# EasyEDA Pro project wukong01-Y003-HTOL.eprj, board PCB1 (continued)
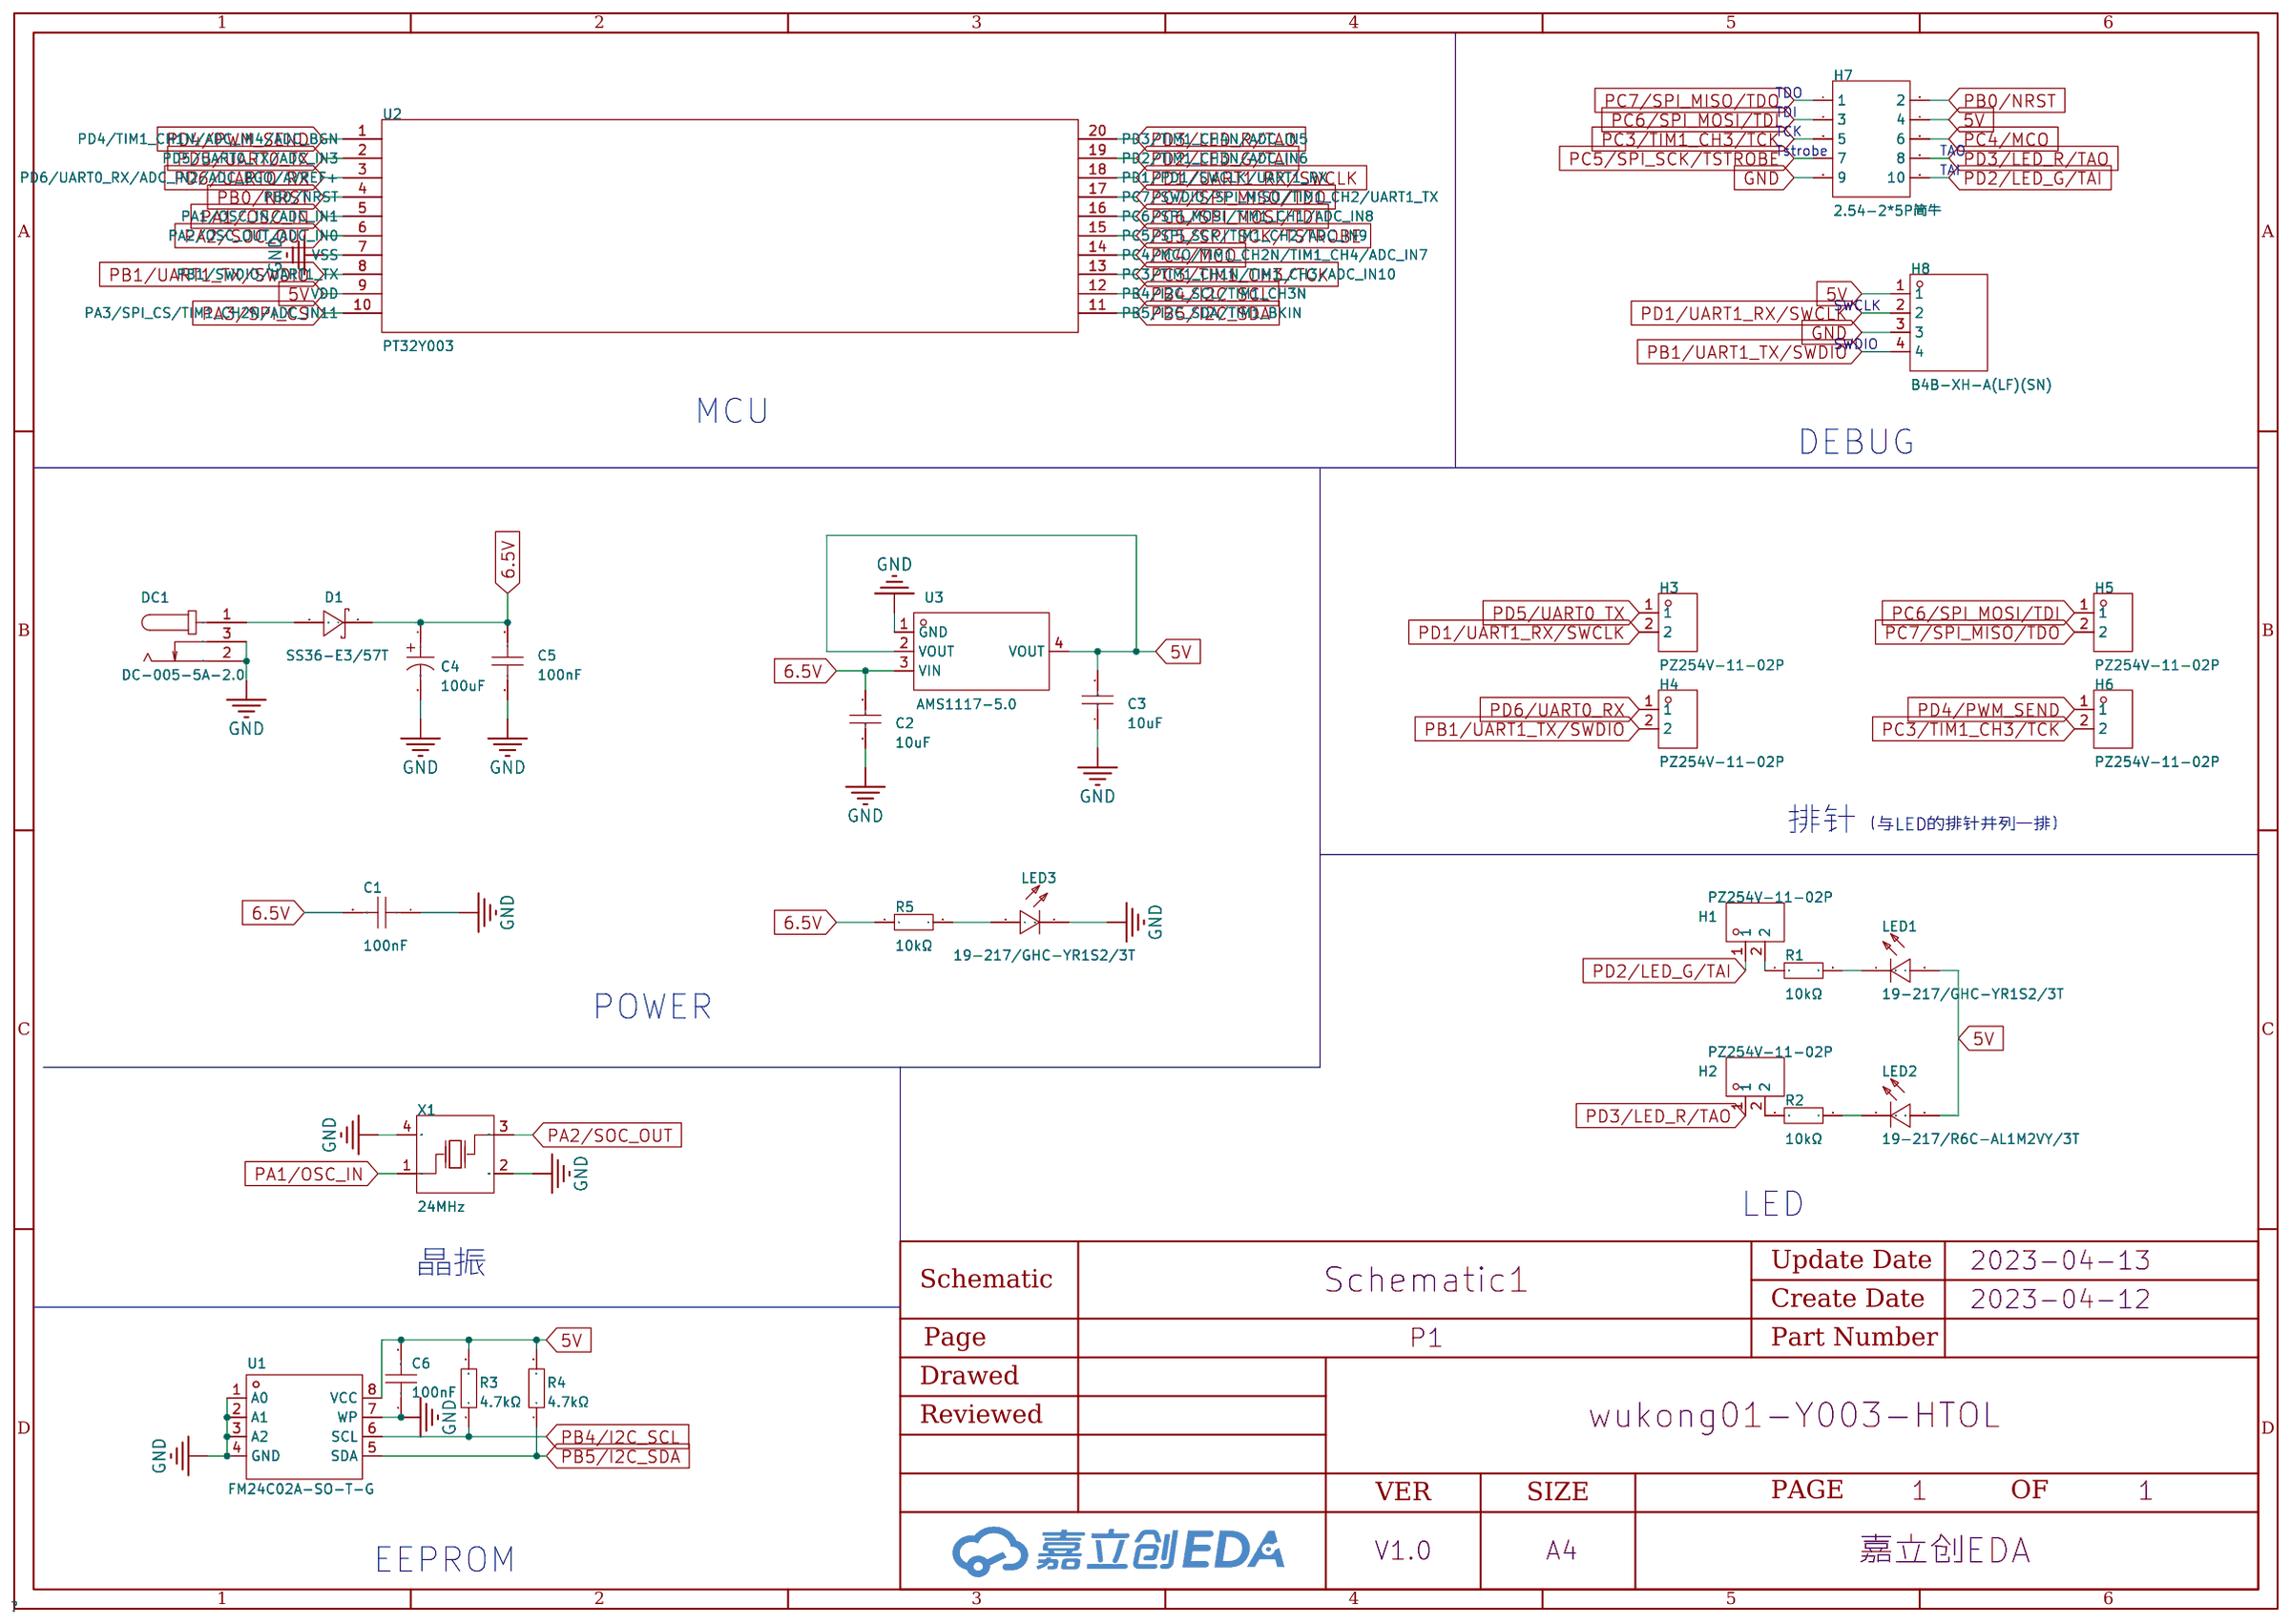
[diagram p0: schematic sheet]
## Nets (continued)
PB4/I2C_SCL: R3.1 R3#2.1 R3#3.1 R3#4.1 R3#5.1 R3#6.1 R3#7.1 R3#8.1 R3#9.1 R3#10.1 R3#11.1 R3#12.1 R3#13.1 R3#14.1 R3#15.1 R3#16.1 R3#17.1 R3#18.1 R3#19.1 R3#20.1 R3#21.1 R3#22.1 R3#23.1 R3#24.1 R3#25.1 R3#26.1 R3#27.1 R3#28.1 R3#29.1 R3#30.1 R3#31.1 R3#32.1 R3#33.1 R3#34.1 R3#35.1 R3#36.1 R3#37.1 R3#38.1 R3#39.1 R3#40.1 U1.6 U1#2.6 U1#3.6 U1#4.6 U1#5.6 U1#6.6 U1#7.6 U1#8.6 U1#9.6 U1#10.6 U1#11.6 U1#12.6 U1#13.6 U1#14.6 U1#15.6 U1#16.6 U1#17.6 U1#18.6 U1#19.6 U1#20.6 U1#21.6 U1#22.6 U1#23.6 U1#24.6 U1#25.6 U1#26.6 U1#27.6 U1#28.6 U1#29.6 U1#30.6 U1#31.6 U1#32.6 U1#33.6 U1#34.6 U1#35.6 U1#36.6 U1#37.6 U1#38.6 U1#39.6 U1#40.6 U2.12 U2#2.12 U2#3.12 U2#4.12 U2#5.12 U2#6.12 U2#7.12 U2#8.12 U2#9.12 U2#10.12 U2#11.12 U2#12.12 U2#13.12 U2#14.12 U2#15.12 U2#16.12 U2#17.12 U2#18.12 U2#19.12 U2#20.12 U2#21.12 U2#22.12 U2#23.12 U2#24.12 U2#25.12 U2#26.12 U2#27.12 U2#28.12 U2#29.12 U2#30.12 U2#31.12 U2#32.12 U2#33.12 U2#34.12 U2#35.12 U2#36.12 U2#37.12 U2#38.12 U2#39.12 U2#40.12
PB5/I2C_SDA: R4.1 R4#2.1 R4#3.1 R4#4.1 R4#5.1 R4#6.1 R4#7.1 R4#8.1 R4#9.1 R4#10.1 R4#11.1 R4#12.1 R4#13.1 R4#14.1 R4#15.1 R4#16.1 R4#17.1 R4#18.1 R4#19.1 R4#20.1 R4#21.1 R4#22.1 R4#23.1 R4#24.1 R4#25.1 R4#26.1 R4#27.1 R4#28.1 R4#29.1 R4#30.1 R4#31.1 R4#32.1 R4#33.1 R4#34.1 R4#35.1 R4#36.1 R4#37.1 R4#38.1 R4#39.1 R4#40.1 U1.5 U1#2.5 U1#3.5 U1#4.5 U1#5.5 U1#6.5 U1#7.5 U1#8.5 U1#9.5 U1#10.5 U1#11.5 U1#12.5 U1#13.5 U1#14.5 U1#15.5 U1#16.5 U1#17.5 U1#18.5 U1#19.5 U1#20.5 U1#21.5 U1#22.5 U1#23.5 U1#24.5 U1#25.5 U1#26.5 U1#27.5 U1#28.5 U1#29.5 U1#30.5 U1#31.5 U1#32.5 U1#33.5 U1#34.5 U1#35.5 U1#36.5 U1#37.5 U1#38.5 U1#39.5 U1#40.5 U2.11 U2#2.11 U2#3.11 U2#4.11 U2#5.11 U2#6.11 U2#7.11 U2#8.11 U2#9.11 U2#10.11 U2#11.11 U2#12.11 U2#13.11 U2#14.11 U2#15.11 U2#16.11 U2#17.11 U2#18.11 U2#19.11 U2#20.11 U2#21.11 U2#22.11 U2#23.11 U2#24.11 U2#25.11 U2#26.11 U2#27.11 U2#28.11 U2#29.11 U2#30.11 U2#31.11 U2#32.11 U2#33.11 U2#34.11 U2#35.11 U2#36.11 U2#37.11 U2#38.11 U2#39.11 U2#40.11
PC3/TIM1_CH3/TCK: H6.2 H6#2.2 H6#3.2 H6#4.2 H6#5.2 H6#6.2 H6#7.2 H6#8.2 H6#9.2 H6#10.2 H6#11.2 H6#12.2 H6#13.2 H6#14.2 H6#15.2 H6#16.2 H6#17.2 H6#18.2 H6#19.2 H6#20.2 H6#21.2 H6#22.2 H6#23.2 H6#24.2 H6#25.2 H6#26.2 H6#27.2 H6#28.2 H6#29.2 H6#30.2 H6#31.2 H6#32.2 H6#33.2 H6#34.2 H6#35.2 H6#36.2 H6#37.2 H6#38.2 H6#39.2 H6#40.2 H7.5 H7#2.5 H7#3.5 H7#4.5 H7#5.5 H7#6.5 H7#7.5 H7#8.5 H7#9.5 H7#10.5 H7#11.5 H7#12.5 H7#13.5 H7#14.5 H7#15.5 H7#16.5 H7#17.5 H7#18.5 H7#19.5 H7#20.5 H7#21.5 H7#22.5 H7#23.5 H7#24.5 H7#25.5 H7#26.5 H7#27.5 H7#28.5 H7#29.5 H7#30.5 H7#31.5 H7#32.5 H7#33.5 H7#34.5 H7#35.5 H7#36.5 H7#37.5 H7#38.5 H7#39.5 H7#40.5 U2.13 U2#2.13 U2#3.13 U2#4.13 U2#5.13 U2#6.13 U2#7.13 U2#8.13 U2#9.13 U2#10.13 U2#11.13 U2#12.13 U2#13.13 U2#14.13 U2#15.13 U2#16.13 U2#17.13 U2#18.13 U2#19.13 U2#20.13 U2#21.13 U2#22.13 U2#23.13 U2#24.13 U2#25.13 U2#26.13 U2#27.13 U2#28.13 U2#29.13 U2#30.13 U2#31.13 U2#32.13 U2#33.13 U2#34.13 U2#35.13 U2#36.13 U2#37.13 U2#38.13 U2#39.13 U2#40.13
PC4/MCO: H7.6 H7#2.6 H7#3.6 H7#4.6 H7#5.6 H7#6.6 H7#7.6 H7#8.6 H7#9.6 H7#10.6 H7#11.6 H7#12.6 H7#13.6 H7#14.6 H7#15.6 H7#16.6 H7#17.6 H7#18.6 H7#19.6 H7#20.6 H7#21.6 H7#22.6 H7#23.6 H7#24.6 H7#25.6 H7#26.6 H7#27.6 H7#28.6 H7#29.6 H7#30.6 H7#31.6 H7#32.6 H7#33.6 H7#34.6 H7#35.6 H7#36.6 H7#37.6 H7#38.6 H7#39.6 H7#40.6 U2.14 U2#2.14 U2#3.14 U2#4.14 U2#5.14 U2#6.14 U2#7.14 U2#8.14 U2#9.14 U2#10.14 U2#11.14 U2#12.14 U2#13.14 U2#14.14 U2#15.14 U2#16.14 U2#17.14 U2#18.14 U2#19.14 U2#20.14 U2#21.14 U2#22.14 U2#23.14 U2#24.14 U2#25.14 U2#26.14 U2#27.14 U2#28.14 U2#29.14 U2#30.14 U2#31.14 U2#32.14 U2#33.14 U2#34.14 U2#35.14 U2#36.14 U2#37.14 U2#38.14 U2#39.14 U2#40.14
PC5/SPI_SCK/TSTROBE: H7.7 H7#2.7 H7#3.7 H7#4.7 H7#5.7 H7#6.7 H7#7.7 H7#8.7 H7#9.7 H7#10.7 H7#11.7 H7#12.7 H7#13.7 H7#14.7 H7#15.7 H7#16.7 H7#17.7 H7#18.7 H7#19.7 H7#20.7 H7#21.7 H7#22.7 H7#23.7 H7#24.7 H7#25.7 H7#26.7 H7#27.7 H7#28.7 H7#29.7 H7#30.7 H7#31.7 H7#32.7 H7#33.7 H7#34.7 H7#35.7 H7#36.7 H7#37.7 H7#38.7 H7#39.7 H7#40.7 U2.15 U2#2.15 U2#3.15 U2#4.15 U2#5.15 U2#6.15 U2#7.15 U2#8.15 U2#9.15 U2#10.15 U2#11.15 U2#12.15 U2#13.15 U2#14.15 U2#15.15 U2#16.15 U2#17.15 U2#18.15 U2#19.15 U2#20.15 U2#21.15 U2#22.15 U2#23.15 U2#24.15 U2#25.15 U2#26.15 U2#27.15 U2#28.15 U2#29.15 U2#30.15 U2#31.15 U2#32.15 U2#33.15 U2#34.15 U2#35.15 U2#36.15 U2#37.15 U2#38.15 U2#39.15 U2#40.15
PC6/SPI_MOSI/TDI: H5.1 H5#2.1 H5#3.1 H5#4.1 H5#5.1 H5#6.1 H5#7.1 H5#8.1 H5#9.1 H5#10.1 H5#11.1 H5#12.1 H5#13.1 H5#14.1 H5#15.1 H5#16.1 H5#17.1 H5#18.1 H5#19.1 H5#20.1 H5#21.1 H5#22.1 H5#23.1 H5#24.1 H5#25.1 H5#26.1 H5#27.1 H5#28.1 H5#29.1 H5#30.1 H5#31.1 H5#32.1 H5#33.1 H5#34.1 H5#35.1 H5#36.1 H5#37.1 H5#38.1 H5#39.1 H5#40.1 H7.3 H7#2.3 H7#3.3 H7#4.3 H7#5.3 H7#6.3 H7#7.3 H7#8.3 H7#9.3 H7#10.3 H7#11.3 H7#12.3 H7#13.3 H7#14.3 H7#15.3 H7#16.3 H7#17.3 H7#18.3 H7#19.3 H7#20.3 H7#21.3 H7#22.3 H7#23.3 H7#24.3 H7#25.3 H7#26.3 H7#27.3 H7#28.3 H7#29.3 H7#30.3 H7#31.3 H7#32.3 H7#33.3 H7#34.3 H7#35.3 H7#36.3 H7#37.3 H7#38.3 H7#39.3 H7#40.3 U2.16 U2#2.16 U2#3.16 U2#4.16 U2#5.16 U2#6.16 U2#7.16 U2#8.16 U2#9.16 U2#10.16 U2#11.16 U2#12.16 U2#13.16 U2#14.16 U2#15.16 U2#16.16 U2#17.16 U2#18.16 U2#19.16 U2#20.16 U2#21.16 U2#22.16 U2#23.16 U2#24.16 U2#25.16 U2#26.16 U2#27.16 U2#28.16 U2#29.16 U2#30.16 U2#31.16 U2#32.16 U2#33.16 U2#34.16 U2#35.16 U2#36.16 U2#37.16 U2#38.16 U2#39.16 U2#40.16
PC7/SPI_MISO/TDO: H5.2 H5#2.2 H5#3.2 H5#4.2 H5#5.2 H5#6.2 H5#7.2 H5#8.2 H5#9.2 H5#10.2 H5#11.2 H5#12.2 H5#13.2 H5#14.2 H5#15.2 H5#16.2 H5#17.2 H5#18.2 H5#19.2 H5#20.2 H5#21.2 H5#22.2 H5#23.2 H5#24.2 H5#25.2 H5#26.2 H5#27.2 H5#28.2 H5#29.2 H5#30.2 H5#31.2 H5#32.2 H5#33.2 H5#34.2 H5#35.2 H5#36.2 H5#37.2 H5#38.2 H5#39.2 H5#40.2 H7.1 H7#2.1 H7#3.1 H7#4.1 H7#5.1 H7#6.1 H7#7.1 H7#8.1 H7#9.1 H7#10.1 H7#11.1 H7#12.1 H7#13.1 H7#14.1 H7#15.1 H7#16.1 H7#17.1 H7#18.1 H7#19.1 H7#20.1 H7#21.1 H7#22.1 H7#23.1 H7#24.1 H7#25.1 H7#26.1 H7#27.1 H7#28.1 H7#29.1 H7#30.1 H7#31.1 H7#32.1 H7#33.1 H7#34.1 H7#35.1 H7#36.1 H7#37.1 H7#38.1 H7#39.1 H7#40.1 U2.17 U2#2.17 U2#3.17 U2#4.17 U2#5.17 U2#6.17 U2#7.17 U2#8.17 U2#9.17 U2#10.17 U2#11.17 U2#12.17 U2#13.17 U2#14.17 U2#15.17 U2#16.17 U2#17.17 U2#18.17 U2#19.17 U2#20.17 U2#21.17 U2#22.17 U2#23.17 U2#24.17 U2#25.17 U2#26.17 U2#27.17 U2#28.17 U2#29.17 U2#30.17 U2#31.17 U2#32.17 U2#33.17 U2#34.17 U2#35.17 U2#36.17 U2#37.17 U2#38.17 U2#39.17 U2#40.17
PD1/UART1_RX/SWCLK: H3.2 H3#2.2 H3#3.2 H3#4.2 H3#5.2 H3#6.2 H3#7.2 H3#8.2 H3#9.2 H3#10.2 H3#11.2 H3#12.2 H3#13.2 H3#14.2 H3#15.2 H3#16.2 H3#17.2 H3#18.2 H3#19.2 H3#20.2 H3#21.2 H3#22.2 H3#23.2 H3#24.2 H3#25.2 H3#26.2 H3#27.2 H3#28.2 H3#29.2 H3#30.2 H3#31.2 H3#32.2 H3#33.2 H3#34.2 H3#35.2 H3#36.2 H3#37.2 H3#38.2 H3#39.2 H3#40.2 H8.2 H8#2.2 H8#3.2 H8#4.2 H8#5.2 H8#6.2 H8#7.2 H8#8.2 H8#9.2 H8#10.2 H8#11.2 H8#12.2 H8#13.2 H8#14.2 H8#15.2 H8#16.2 H8#17.2 H8#18.2 H8#19.2 H8#20.2 H8#21.2 H8#22.2 H8#23.2 H8#24.2 H8#25.2 H8#26.2 H8#27.2 H8#28.2 H8#29.2 H8#30.2 H8#31.2 H8#32.2 H8#33.2 H8#34.2 H8#35.2 H8#36.2 H8#37.2 H8#38.2 H8#39.2 H8#40.2 U2.18 U2#2.18 U2#3.18 U2#4.18 U2#5.18 U2#6.18 U2#7.18 U2#8.18 U2#9.18 U2#10.18 U2#11.18 U2#12.18 U2#13.18 U2#14.18 U2#15.18 U2#16.18 U2#17.18 U2#18.18 U2#19.18 U2#20.18 U2#21.18 U2#22.18 U2#23.18 U2#24.18 U2#25.18 U2#26.18 U2#27.18 U2#28.18 U2#29.18 U2#30.18 U2#31.18 U2#32.18 U2#33.18 U2#34.18 U2#35.18 U2#36.18 U2#37.18 U2#38.18 U2#39.18 U2#40.18
PD2/LED_G/TAI: H1.1 H1#2.1 H1#3.1 H1#4.1 H1#5.1 H1#6.1 H1#7.1 H1#8.1 H1#9.1 H1#10.1 H1#11.1 H1#12.1 H1#13.1 H1#14.1 H1#15.1 H1#16.1 H1#17.1 H1#18.1 H1#19.1 H1#20.1 H1#21.1 H1#22.1 H1#23.1 H1#24.1 H1#25.1 H1#26.1 H1#27.1 H1#28.1 H1#29.1 H1#30.1 H1#31.1 H1#32.1 H1#33.1 H1#34.1 H1#35.1 H1#36.1 H1#37.1 H1#38.1 H1#39.1 H1#40.1 H7.10 H7#2.10 H7#3.10 H7#4.10 H7#5.10 H7#6.10 H7#7.10 H7#8.10 H7#9.10 H7#10.10 H7#11.10 H7#12.10 H7#13.10 H7#14.10 H7#15.10 H7#16.10 H7#17.10 H7#18.10 H7#19.10 H7#20.10 H7#21.10 H7#22.10 H7#23.10 H7#24.10 H7#25.10 H7#26.10 H7#27.10 H7#28.10 H7#29.10 H7#30.10 H7#31.10 H7#32.10 H7#33.10 H7#34.10 H7#35.10 H7#36.10 H7#37.10 H7#38.10 H7#39.10 H7#40.10 U2.19 U2#2.19 U2#3.19 U2#4.19 U2#5.19 U2#6.19 U2#7.19 U2#8.19 U2#9.19 U2#10.19 U2#11.19 U2#12.19 U2#13.19 U2#14.19 U2#15.19 U2#16.19 U2#17.19 U2#18.19 U2#19.19 U2#20.19 U2#21.19 U2#22.19 U2#23.19 U2#24.19 U2#25.19 U2#26.19 U2#27.19 U2#28.19 U2#29.19 U2#30.19 U2#31.19 U2#32.19 U2#33.19 U2#34.19 U2#35.19 U2#36.19 U2#37.19 U2#38.19 U2#39.19 U2#40.19
PD3/LED_R/TAO: H2.1 H2#2.1 H2#3.1 H2#4.1 H2#5.1 H2#6.1 H2#7.1 H2#8.1 H2#9.1 H2#10.1 H2#11.1 H2#12.1 H2#13.1 H2#14.1 H2#15.1 H2#16.1 H2#17.1 H2#18.1 H2#19.1 H2#20.1 H2#21.1 H2#22.1 H2#23.1 H2#24.1 H2#25.1 H2#26.1 H2#27.1 H2#28.1 H2#29.1 H2#30.1 H2#31.1 H2#32.1 H2#33.1 H2#34.1 H2#35.1 H2#36.1 H2#37.1 H2#38.1 H2#39.1 H2#40.1 H7.8 H7#2.8 H7#3.8 H7#4.8 H7#5.8 H7#6.8 H7#7.8 H7#8.8 H7#9.8 H7#10.8 H7#11.8 H7#12.8 H7#13.8 H7#14.8 H7#15.8 H7#16.8 H7#17.8 H7#18.8 H7#19.8 H7#20.8 H7#21.8 H7#22.8 H7#23.8 H7#24.8 H7#25.8 H7#26.8 H7#27.8 H7#28.8 H7#29.8 H7#30.8 H7#31.8 H7#32.8 H7#33.8 H7#34.8 H7#35.8 H7#36.8 H7#37.8 H7#38.8 H7#39.8 H7#40.8 U2.20 U2#2.20 U2#3.20 U2#4.20 U2#5.20 U2#6.20 U2#7.20 U2#8.20 U2#9.20 U2#10.20 U2#11.20 U2#12.20 U2#13.20 U2#14.20 U2#15.20 U2#16.20 U2#17.20 U2#18.20 U2#19.20 U2#20.20 U2#21.20 U2#22.20 U2#23.20 U2#24.20 U2#25.20 U2#26.20 U2#27.20 U2#28.20 U2#29.20 U2#30.20 U2#31.20 U2#32.20 U2#33.20 U2#34.20 U2#35.20 U2#36.20 U2#37.20 U2#38.20 U2#39.20 U2#40.20
PD4/PWM_SEND: H6.1 H6#2.1 H6#3.1 H6#4.1 H6#5.1 H6#6.1 H6#7.1 H6#8.1 H6#9.1 H6#10.1 H6#11.1 H6#12.1 H6#13.1 H6#14.1 H6#15.1 H6#16.1 H6#17.1 H6#18.1 H6#19.1 H6#20.1 H6#21.1 H6#22.1 H6#23.1 H6#24.1 H6#25.1 H6#26.1 H6#27.1 H6#28.1 H6#29.1 H6#30.1 H6#31.1 H6#32.1 H6#33.1 H6#34.1 H6#35.1 H6#36.1 H6#37.1 H6#38.1 H6#39.1 H6#40.1 U2.1 U2#2.1 U2#3.1 U2#4.1 U2#5.1 U2#6.1 U2#7.1 U2#8.1 U2#9.1 U2#10.1 U2#11.1 U2#12.1 U2#13.1 U2#14.1 U2#15.1 U2#16.1 U2#17.1 U2#18.1 U2#19.1 U2#20.1 U2#21.1 U2#22.1 U2#23.1 U2#24.1 U2#25.1 U2#26.1 U2#27.1 U2#28.1 U2#29.1 U2#30.1 U2#31.1 U2#32.1 U2#33.1 U2#34.1 U2#35.1 U2#36.1 U2#37.1 U2#38.1 U2#39.1 U2#40.1
PD5/UART0_TX: H3.1 H3#2.1 H3#3.1 H3#4.1 H3#5.1 H3#6.1 H3#7.1 H3#8.1 H3#9.1 H3#10.1 H3#11.1 H3#12.1 H3#13.1 H3#14.1 H3#15.1 H3#16.1 H3#17.1 H3#18.1 H3#19.1 H3#20.1 H3#21.1 H3#22.1 H3#23.1 H3#24.1 H3#25.1 H3#26.1 H3#27.1 H3#28.1 H3#29.1 H3#30.1 H3#31.1 H3#32.1 H3#33.1 H3#34.1 H3#35.1 H3#36.1 H3#37.1 H3#38.1 H3#39.1 H3#40.1 U2.2 U2#2.2 U2#3.2 U2#4.2 U2#5.2 U2#6.2 U2#7.2 U2#8.2 U2#9.2 U2#10.2 U2#11.2 U2#12.2 U2#13.2 U2#14.2 U2#15.2 U2#16.2 U2#17.2 U2#18.2 U2#19.2 U2#20.2 U2#21.2 U2#22.2 U2#23.2 U2#24.2 U2#25.2 U2#26.2 U2#27.2 U2#28.2 U2#29.2 U2#30.2 U2#31.2 U2#32.2 U2#33.2 U2#34.2 U2#35.2 U2#36.2 U2#37.2 U2#38.2 U2#39.2 U2#40.2
PD6/UART0_RX: H4.1 H4#2.1 H4#3.1 H4#4.1 H4#5.1 H4#6.1 H4#7.1 H4#8.1 H4#9.1 H4#10.1 H4#11.1 H4#12.1 H4#13.1 H4#14.1 H4#15.1 H4#16.1 H4#17.1 H4#18.1 H4#19.1 H4#20.1 H4#21.1 H4#22.1 H4#23.1 H4#24.1 H4#25.1 H4#26.1 H4#27.1 H4#28.1 H4#29.1 H4#30.1 H4#31.1 H4#32.1 H4#33.1 H4#34.1 H4#35.1 H4#36.1 H4#37.1 H4#38.1 H4#39.1 H4#40.1 U2.3 U2#2.3 U2#3.3 U2#4.3 U2#5.3 U2#6.3 U2#7.3 U2#8.3 U2#9.3 U2#10.3 U2#11.3 U2#12.3 U2#13.3 U2#14.3 U2#15.3 U2#16.3 U2#17.3 U2#18.3 U2#19.3 U2#20.3 U2#21.3 U2#22.3 U2#23.3 U2#24.3 U2#25.3 U2#26.3 U2#27.3 U2#28.3 U2#29.3 U2#30.3 U2#31.3 U2#32.3 U2#33.3 U2#34.3 U2#35.3 U2#36.3 U2#37.3 U2#38.3 U2#39.3 U2#40.3
$1N849: LED1.1 LED1#2.1 LED1#3.1 LED1#4.1 LED1#5.1 LED1#6.1 LED1#7.1 LED1#8.1 LED1#9.1 LED1#10.1 LED1#11.1 LED1#12.1 LED1#13.1 LED1#14.1 LED1#15.1 LED1#16.1 LED1#17.1 LED1#18.1 LED1#19.1 LED1#20.1 LED1#21.1 LED1#22.1 LED1#23.1 LED1#24.1 LED1#25.1 LED1#26.1 LED1#27.1 LED1#28.1 LED1#29.1 LED1#30.1 LED1#31.1 LED1#32.1 LED1#33.1 LED1#34.1 LED1#35.1 LED1#36.1 LED1#37.1 LED1#38.1 LED1#39.1 LED1#40.1 R1.2 R1#2.2 R1#3.2 R1#4.2 R1#5.2 R1#6.2 R1#7.2 R1#8.2 R1#9.2 R1#10.2 R1#11.2 R1#12.2 R1#13.2 R1#14.2 R1#15.2 R1#16.2 R1#17.2 R1#18.2 R1#19.2 R1#20.2 R1#21.2 R1#22.2 R1#23.2 R1#24.2 R1#25.2 R1#26.2 R1#27.2 R1#28.2 R1#29.2 R1#30.2 R1#31.2 R1#32.2 R1#33.2 R1#34.2 R1#35.2 R1#36.2 R1#37.2 R1#38.2 R1#39.2 R1#40.2
$1N852: LED2.2 LED2#2.2 LED2#3.2 LED2#4.2 LED2#5.2 LED2#6.2 LED2#7.2 LED2#8.2 LED2#9.2 LED2#10.2 LED2#11.2 LED2#12.2 LED2#13.2 LED2#14.2 LED2#15.2 LED2#16.2 LED2#17.2 LED2#18.2 LED2#19.2 LED2#20.2 LED2#21.2 LED2#22.2 LED2#23.2 LED2#24.2 LED2#25.2 LED2#26.2 LED2#27.2 LED2#28.2 LED2#29.2 LED2#30.2 LED2#31.2 LED2#32.2 LED2#33.2 LED2#34.2 LED2#35.2 LED2#36.2 LED2#37.2 LED2#38.2 LED2#39.2 LED2#40.2 R2.2 R2#2.2 R2#3.2 R2#4.2 R2#5.2 R2#6.2 R2#7.2 R2#8.2 R2#9.2 R2#10.2 R2#11.2 R2#12.2 R2#13.2 R2#14.2 R2#15.2 R2#16.2 R2#17.2 R2#18.2 R2#19.2 R2#20.2 R2#21.2 R2#22.2 R2#23.2 R2#24.2 R2#25.2 R2#26.2 R2#27.2 R2#28.2 R2#29.2 R2#30.2 R2#31.2 R2#32.2 R2#33.2 R2#34.2 R2#35.2 R2#36.2 R2#37.2 R2#38.2 R2#39.2 R2#40.2
$1N3085: H1.2 H1#2.2 H1#3.2 H1#4.2 H1#5.2 H1#6.2 H1#7.2 H1#8.2 H1#9.2 H1#10.2 H1#11.2 H1#12.2 H1#13.2 H1#14.2 H1#15.2 H1#16.2 H1#17.2 H1#18.2 H1#19.2 H1#20.2 H1#21.2 H1#22.2 H1#23.2 H1#24.2 H1#25.2 H1#26.2 H1#27.2 H1#28.2 H1#29.2 H1#30.2 H1#31.2 H1#32.2 H1#33.2 H1#34.2 H1#35.2 H1#36.2 H1#37.2 H1#38.2 H1#39.2 H1#40.2 R1.1 R1#2.1 R1#3.1 R1#4.1 R1#5.1 R1#6.1 R1#7.1 R1#8.1 R1#9.1 R1#10.1 R1#11.1 R1#12.1 R1#13.1 R1#14.1 R1#15.1 R1#16.1 R1#17.1 R1#18.1 R1#19.1 R1#20.1 R1#21.1 R1#22.1 R1#23.1 R1#24.1 R1#25.1 R1#26.1 R1#27.1 R1#28.1 R1#29.1 R1#30.1 R1#31.1 R1#32.1 R1#33.1 R1#34.1 R1#35.1 R1#36.1 R1#37.1 R1#38.1 R1#39.1 R1#40.1
$1N3176: H2.2 H2#2.2 H2#3.2 H2#4.2 H2#5.2 H2#6.2 H2#7.2 H2#8.2 H2#9.2 H2#10.2 H2#11.2 H2#12.2 H2#13.2 H2#14.2 H2#15.2 H2#16.2 H2#17.2 H2#18.2 H2#19.2 H2#20.2 H2#21.2 H2#22.2 H2#23.2 H2#24.2 H2#25.2 H2#26.2 H2#27.2 H2#28.2 H2#29.2 H2#30.2 H2#31.2 H2#32.2 H2#33.2 H2#34.2 H2#35.2 H2#36.2 H2#37.2 H2#38.2 H2#39.2 H2#40.2 R2.1 R2#2.1 R2#3.1 R2#4.1 R2#5.1 R2#6.1 R2#7.1 R2#8.1 R2#9.1 R2#10.1 R2#11.1 R2#12.1 R2#13.1 R2#14.1 R2#15.1 R2#16.1 R2#17.1 R2#18.1 R2#19.1 R2#20.1 R2#21.1 R2#22.1 R2#23.1 R2#24.1 R2#25.1 R2#26.1 R2#27.1 R2#28.1 R2#29.1 R2#30.1 R2#31.1 R2#32.1 R2#33.1 R2#34.1 R2#35.1 R2#36.1 R2#37.1 R2#38.1 R2#39.1 R2#40.1
$1N6085: LED3.2 R5.1
$1N6296: D1.1 DC1.1

## Via types
v1: diameter 0.61, hole 0.305, Top Layer to Bottom Layer, 1964 vias

## Routing (per net, layer and track width the routed paths; a pad name or vN(x,y) marks a point on that pad's centre or on a via; arc(x,y) is an arc through that point)
5V: length 6851.1
  Top Layer w0.5: LED1#11.2 225.01,264.8 R4#15.2 ; 69.46,186.45 65.14,186.45 U1#29.8 ; 69.46,186.45 69.53,186.38 C6#31.2 v1(72.76,185.17) ; 69.46,186.45 U2#33.9 ; R3#4.2 v1(219.83,96.01) ; R3#4.2 R4#4.2 ; R3#4.2 224.96,94.74 LED2#5.1 ; 125.02,143.52 118.48,143.52 ; 118.48,143.52 118.56,143.45 C6#36.2 v1(121.78,142.24) ; 118.48,143.52 114.16,143.52 U1#37.8 ; U2#32.9 216.53,186.45 ; 216.53,186.45 212.21,186.45 U1#32.8 ; 216.53,186.45 216.6,186.38 C6#34.2 v1(219.83,185.17) ; LED2#13.1 126.91,266.45 R3#11.2 ; U2#8.9 20.44,100.59 ; 20.44,100.59 20.51,100.52 C6#7.2 v1(23.74,99.31) ; 20.44,100.59 16.12,100.59 U1#5.8 ; v1(219.83,56.39) C6#23.2 216.6,57.6 216.53,57.67 ; 8.26,132.59 v1(8.26,123.7) 8.26,93.98 10.54,91.69 23.74,91.69 R4#7.2 ; 8.26,132.59 7.11,133.73 7.11,259.84 8.89,261.62 23.88,261.62 U3#2.4 U3#2.2 ; 8.26,132.59 57.28,132.59 ; H8#2.1 v1(159.38,123.7) ; R4#5.2 R3#5.2 ; R4#5.2 72.76,91.69 59.56,91.69 57.28,93.98 v1(57.28,123.7) 57.28,132.59 ; R4#5.2 77.94,93.09 LED1#6.2 ; R3#5.2 v1(72.76,96.01) ; R3#5.2 77.89,94.74 LED2#6.1 ; 216.53,14.74 212.21,14.74 U1#19.8 ; 216.53,14.74 216.6,14.67 C6#22.2 v1(219.83,13.46) ; 216.53,14.74 U2#21.9 ; 155.32,132.59 v1(155.32,123.7) 155.32,93.98 157.61,91.69 170.81,91.69 R4#6.2 ; 155.32,132.59 106.3,132.59 ; 155.32,132.59 204.34,132.59 ; R4#13.2 126.96,50.17 LED1#19.2 ; R4#13.2 R3#15.2 ; R4#13.2 121.78,48.77 108.58,48.77 106.3,51.05 v1(106.3,80.77) 106.3,89.66 ; 261.22,229.36 261.23,229.37 265.55,229.37 ; U2#3.9 265.55,100.59 ; 265.55,100.59 261.23,100.59 261.22,100.58 ; 265.55,100.59 265.62,100.52 C6#5.2 v1(268.85,99.31) ; 8.26,177.55 v1(8.26,209.55) 8.26,218.44 ; 8.26,177.55 23.74,177.55 R4#35.2 ; 8.26,177.55 8.26,175.51 ; 106.3,304.29 57.28,304.29 v1(57.28,295.4) 57.28,291.6 ; 106.3,304.29 155.32,304.29 ; 106.3,304.29 v1(106.3,295.4) 106.3,265.68 108.58,263.4 121.78,263.4 R4#10.2 ; 167.51,229.37 167.58,229.3 C6#26.2 v1(170.81,228.09) ; 167.51,229.37 163.19,229.37 U1#28.8 ; 167.51,229.37 U2#28.9 ; H8#15.1 v1(208.41,295.4) ; R4#18.2 225.01,7.24 LED1#15.2 ; R4#18.2 219.83,5.84 206.63,5.84 204.34,8.13 v1(204.34,37.85) 204.34,45.18 202.79,46.74 155.32,46.74 ; R4#18.2 R3#19.2 ; H8#12.1 v1(61.34,80.77) ; U2#13.9 265.55,272.3 ; 265.55,272.3 265.62,272.23 C6#11.2 v1(268.85,271.02) ; 265.55,272.3 261.23,272.3 261.22,272.29 ; H8#36.1 v1(159.38,166.62) ; R4#6.2 R3#8.2 ; R4#6.2 175.98,93.09 LED1#5.2 ; R3#8.2 v1(170.81,96.01) ; R3#8.2 175.93,94.74 LED2#9.1 ; v1(72.76,13.46) C6#20.2 69.53,14.67 69.46,14.74 ; LED1#25.2 28.92,221.87 R4#29.2 ; v1(23.74,228.09) C6#29.2 20.51,229.3 20.44,229.37 ; R3#13.2 v1(219.83,267.72) ; R3#13.2 224.96,266.45 LED2#15.1 ; R3#13.2 R4#15.2 ; v1(170.81,271.02) C6#9.2 167.58,272.23 167.51,272.3 ; 223.06,143.52 216.53,143.52 ; 216.53,143.52 216.6,143.45 C6#40.2 v1(219.83,142.24) ; 216.53,143.52 212.21,143.52 U1#38.8 ; R4#22.2 28.92,7.24 LED1#12.2 ; R4#22.2 23.74,5.84 10.54,5.84 8.26,8.13 v1(8.26,37.85) 8.26,46.74 ; R4#22.2 R3#22.2 ; R4#15.2 219.83,263.4 206.63,263.4 204.34,265.68 v1(204.34,295.4) 204.34,304.29 ; 253.37,304.29 299.59,304.29 302.13,301.75 302.13,263.78 299.72,261.37 253.37,261.37 ; 253.37,304.29 v1(253.37,295.4) 253.37,265.68 255.65,263.4 268.85,263.4 R4#11.2 ; 253.37,304.29 204.34,304.29 ; R3#12.2 v1(268.85,267.72) ; R3#12.2 R4#11.2 ; R3#12.2 273.98,266.45 LED2#14.1 ; 204.34,218.44 252.35,218.44 253.37,217.42 v1(253.37,209.55) 253.37,179.83 255.65,177.55 268.85,177.55 R4#31.2 ; 204.34,218.44 155.32,218.44 ; 204.34,218.44 v1(204.34,209.55) 204.34,179.83 206.63,177.55 219.83,177.55 R4#32.2 ; H8#34.1 v1(12.32,209.55) ; 253.37,261.37 204.34,261.37 ; 253.37,261.37 v1(253.37,252.48) 253.37,222.76 255.65,220.47 268.85,220.47 R4#25.2 ; R3#19.2 v1(219.83,10.16) ; R3#19.2 224.96,8.89 LED2#24.1 ; LED1#21.2 77.94,7.24 R4#23.2 ; v1(23.74,13.46) C6#17.2 20.51,14.67 20.44,14.74 ; R3#25.2 v1(121.78,224.79) ; R3#25.2 126.91,223.52 LED2#30.1 ; R3#25.2 R4#24.2 ; 155.32,218.44 106.3,218.44 ; 155.32,218.44 v1(155.32,209.55) 155.32,179.83 157.61,177.55 170.81,177.55 R4#34.2 ; R3#29.2 v1(23.74,224.79) ; R3#29.2 R4#29.2 ; R3#29.2 28.87,223.52 LED2#29.1 ; 253.37,132.59 v1(253.37,123.7) 253.37,93.98 255.65,91.69 268.85,91.69 R4#3.2 ; 253.37,132.59 302.26,132.59 ; 253.37,132.59 204.34,132.59 ; U2#26.9 216.53,229.37 ; 216.53,229.37 216.6,229.3 C6#28.2 v1(219.83,228.09) ; 216.53,229.37 212.21,229.37 U1#26.8 ; 204.34,304.29 155.32,304.29 ; U1#13.8 212.21,272.3 216.53,272.3 ; H8#19.1 v1(159.38,37.85) ; U3#3.2 U3#3.4 37.06,265.9 37.19,265.77 37.19,262.62 35.05,260.48 9.52,260.48 8.26,259.22 v1(8.26,252.48) 8.26,220.47 ; R3#23.2 126.91,8.89 LED2#19.1 ; R3#23.2 R4#19.2 ; R3#23.2 v1(121.78,10.16) ; 106.3,46.74 v1(106.3,37.85) 106.3,8.13 108.58,5.84 121.78,5.84 R4#19.2 ; 106.3,46.74 57.28,46.74 ; 106.3,46.74 155.32,46.74 ; R3#16.2 175.93,8.89 LED2#18.1 ; R3#16.2 R4#20.2 ; R3#16.2 v1(170.81,10.16) ; R3#20.2 224.96,51.82 LED2#20.1 ; R3#20.2 R4#21.2 ; R3#20.2 v1(219.83,53.09) ; LED2#28.1 77.89,223.52 R3#27.2 ; H8#13.1 v1(159.38,80.77) ; v1(268.85,142.24) C6#39.2 265.62,143.45 265.55,143.52 ; 167.51,100.59 163.19,100.59 U1#6.8 ; 167.51,100.59 U2#6.9 ; 167.51,100.59 167.58,100.52 C6#4.2 v1(170.81,99.31) ; v1(72.76,56.39) C6#18.2 69.53,57.6 69.46,57.67 ; 167.51,186.45 167.58,186.38 C6#32.2 v1(170.81,185.17) ; 167.51,186.45 U2#34.9 ; 167.51,186.45 163.19,186.45 U1#34.8 ; v1(121.78,228.09) C6#24.2 118.56,229.3 118.48,229.37 ; 216.53,272.3 216.6,272.23 C6#12.2 v1(219.83,271.02) ; 216.53,272.3 U2#16.9 ; LED1#27.2 175.98,221.87 R4#28.2 ; U2#4.9 216.53,100.59 ; 216.53,100.59 212.21,100.59 U1#4.8 ; 216.53,100.59 216.6,100.52 C6#6.2 v1(219.83,99.31) ; U1#9.8 114.16,272.3 118.48,272.3 ; 118.48,186.45 118.56,186.38 C6#30.2 v1(121.78,185.17) ; 118.48,186.45 U2#30.9 ; 118.48,186.45 114.16,186.45 U1#31.8 ; v1(170.81,142.24) C6#38.2 167.58,143.45 167.51,143.52 ; R3#3.2 v1(121.78,96.01) ; R3#3.2 R4#2.2 ; R3#3.2 126.91,94.74 LED2#8.1 ; R4#7.2 28.92,93.09 LED1#3.2 ; R4#7.2 R3#7.2 ; 57.28,46.74 v1(57.28,37.85) 57.28,8.13 59.56,5.84 72.76,5.84 R4#23.2 ; 57.28,46.74 8.26,46.74 ; 57.28,291.6 57.28,265.68 59.56,263.4 72.76,263.4 R4#8.2 ; 57.28,291.6 57.27,291.59 U3#4.4 U3#4.2 ; R3#36.2 v1(170.81,181.86) ; R3#36.2 175.93,180.59 LED2#37.1 ; R3#36.2 R4#34.2 ; R4#29.2 23.74,220.47 8.26,220.47 ; R3#31.2 v1(121.78,181.86) ; R3#31.2 126.91,180.59 LED2#36.1 ; R3#31.2 R4#30.2 ; R3#35.2 v1(23.74,181.86) ; R3#35.2 R4#35.2 ; R3#35.2 28.87,180.59 LED2#35.1 ; 216.53,57.67 212.21,57.67 U1#15.8 ; 216.53,57.67 U2#19.9 ; v1(268.85,228.09) C6#27.2 265.62,229.3 265.55,229.37 ; R4#36.2 126.96,136.02 LED1#35.2 ; R4#36.2 R3#37.2 ; R4#36.2 121.78,134.62 108.58,134.62 106.3,136.91 v1(106.3,166.62) 106.3,174.54 105.32,175.51 57.28,175.51 ; R3#32.2 v1(219.83,181.86) ; R3#32.2 R4#32.2 ; R3#32.2 224.96,180.59 LED2#33.1 ; R4#10.2 126.96,264.8 LED1#8.2 ; R4#10.2 R3#11.2 ; v1(268.85,185.17) C6#33.2 265.62,186.38 265.55,186.45 ; H8#4.1 v1(257.43,123.7) ; U2#35.9 20.44,186.45 ; 20.44,186.45 20.51,186.38 C6#35.2 v1(23.74,185.17) ; 20.44,186.45 16.12,186.45 U1#33.8 ; R4#27.2 77.94,221.87 LED1#28.2 ; R4#27.2 72.76,220.47 59.56,220.47 57.28,222.76 v1(57.28,252.48) 57.28,260.22 58.42,261.37 106.3,261.37 ; R4#27.2 R3#27.2 ; U1#11.8 65.14,57.67 69.46,57.67 ; 57.28,218.44 8.26,218.44 ; 57.28,218.44 106.3,218.44 ; 57.28,218.44 v1(57.28,209.55) 57.28,179.83 59.56,177.55 72.76,177.55 R4#33.2 ; 8.26,218.44 8.26,220.47 ; 69.46,100.59 65.14,100.59 U1.8 ; 69.46,100.59 U2#5.9 ; 69.46,100.59 69.53,100.52 C6#3.2 v1(72.76,99.31) ; U2#10.9 167.51,272.3 ; 167.51,272.3 163.19,272.3 U1#8.8 ; R4#16.2 28.92,50.17 LED1#18.2 ; R4#16.2 23.74,48.77 10.54,48.77 8.26,51.05 v1(8.26,80.77) 8.26,89.66 ; R4#16.2 R3#24.2 ; R4#9.2 175.98,264.8 LED1#9.2 ; R4#9.2 R3#10.2 ; R4#9.2 170.81,263.4 157.61,263.4 155.32,265.68 v1(155.32,295.4) 155.32,304.29 ; H8#28.1 v1(12.32,252.48) ; U2#11.9 118.48,272.3 ; 118.48,272.3 118.56,272.23 C6#10.2 v1(121.78,271.02) ; 155.32,89.66 202.87,89.66 204.34,88.19 v1(204.34,80.77) 204.34,51.05 206.63,48.77 219.83,48.77 R4#21.2 ; 155.32,89.66 v1(155.32,80.77) 155.32,51.05 157.61,48.77 170.81,48.77 R4#12.2 ; 155.32,89.66 8.26,89.66 ; H8#35.1 v1(61.34,166.62) ; LED2#38.1 273.98,180.59 R3#34.2 ; 106.3,218.44 v1(106.3,209.55) 106.3,179.83 108.58,177.55 121.78,177.55 R4#30.2 ; v1(170.81,13.46) C6#19.2 167.58,14.67 167.51,14.74 ; LED1#4.2 274.03,93.09 R4#3.2 ; 155.32,261.37 v1(155.32,252.48) 155.32,222.76 157.61,220.47 170.81,220.47 R4#28.2 ; 155.32,261.37 204.34,261.37 ; 155.32,261.37 106.3,261.37 ; 5.97,89.66 5.97,49.02 8.26,46.74 ; 5.97,89.66 8.26,89.66 ; 5.97,89.66 5.97,261.62 7.37,263.02 11.05,263.02 11.05,265.81 10.92,265.94 U3.4 10.92,274.89 ; H8#31.1 v1(110.36,209.55) ; R4#3.2 R3#6.2 ; R3#6.2 273.98,94.74 LED2#10.1 ; R3#6.2 v1(268.85,96.01) ; U2#7.9 167.51,57.67 ; 167.51,57.67 167.58,57.6 C6#21.2 v1(170.81,56.39) ; 167.51,57.67 163.19,57.67 U1#17.8 ; LED1#10.2 225.01,50.17 R4#21.2 ; LED1#37.2 28.92,136.02 R4.2 ; R3#38.2 224.96,137.67 LED2#39.1 ; R3#38.2 R4#38.2 ; R3#38.2 v1(219.83,138.94) ; H8#17.1 v1(12.32,37.85) ; H8#7.1 v1(61.34,295.4) ; v1(72.76,228.09) C6#25.2 69.53,229.3 69.46,229.37 ; R3#2.2 v1(170.81,138.94) ; R3#2.2 R4#40.2 ; R3#2.2 175.93,137.67 LED2#3.1 ; LED2#2.1 126.91,137.67 R3#37.2 ; U2#27.9 69.46,229.37 ; 69.46,229.37 65.14,229.37 U1#23.8 ; R4#32.2 225.01,178.94 LED1#30.2 ; 20.44,143.52 20.51,143.45 C6.2 v1(23.74,142.24) ; 20.44,143.52 26.97,143.52 ; 20.44,143.52 16.12,143.52 U1#39.8 ; v1(121.78,13.46) C6#14.2 118.56,14.67 118.48,14.74 ; H8#22.1 v1(208.41,80.77) ; 106.3,261.37 v1(106.3,252.48) 106.3,222.76 108.58,220.47 121.78,220.47 R4#24.2 ; 204.34,261.37 v1(204.34,252.48) 204.34,222.76 206.63,220.47 219.83,220.47 R4#26.2 ; R4#2.2 121.78,91.69 108.58,91.69 106.3,93.98 v1(106.3,123.7) 106.3,132.59 ; R4#2.2 126.96,93.09 LED1.2 ; 265.55,57.67 261.23,57.67 261.22,57.66 ; 265.55,57.67 U2#12.9 ; 265.55,57.67 265.62,57.6 C6#15.2 v1(268.85,56.39) ; U2#25.9 265.55,229.37 ; U1#40.8 163.19,143.52 167.51,143.52 ; 20.44,57.67 20.51,57.6 C6#16.2 v1(23.74,56.39) ; 20.44,57.67 16.12,57.67 U1#22.8 ; 20.44,57.67 U2#20.9 ; U1#18.8 114.16,57.67 118.48,57.67 ; H8.1 v1(61.34,123.7) ; 155.32,46.74 v1(155.32,37.85) 155.32,8.13 157.61,5.84 170.81,5.84 R4#20.2 ; 118.48,100.59 114.16,100.59 U1#3.8 ; 118.48,100.59 118.56,100.52 C6#2.2 v1(121.78,99.31) ; 118.48,100.59 U2#2.9 ; R4#39.2 72.76,134.62 59.56,134.62 57.28,136.91 v1(57.28,166.62) 57.28,175.51 ; R4#39.2 77.94,136.02 LED1#40.2 ; R4#39.2 R3#39.2 ; LED1#24.2 225.01,221.87 R4#26.2 ; 167.51,14.74 U2#17.9 ; 167.51,14.74 163.19,14.74 U1#20.8 ; 57.28,175.51 8.26,175.51 ; U1#35.8 65.14,143.52 69.46,143.52 ; R4#12.2 175.98,50.17 LED1#14.2 ; R4#12.2 R3#18.2 ; LED2#22.1 126.91,51.82 R3#15.2 ; R3#18.2 v1(170.81,53.09) ; R3#18.2 175.93,51.82 LED2#23.1 ; R4#4.2 225.01,93.09 LED1#2.2 ; R4#4.2 219.83,91.69 206.63,91.69 204.34,93.98 v1(204.34,123.7) 204.34,132.59 ; U2#15.9 118.48,57.67 ; 118.48,57.67 118.56,57.6 C6#13.2 v1(121.78,56.39) ; H8#14.1 v1(257.43,80.77) ; R4#11.2 274.03,264.8 LED1#13.2 ; U1#12.8 16.12,14.74 20.44,14.74 ; R4#28.2 R3#30.2 ; 118.48,14.74 114.16,14.74 U1#21.8 ; 118.48,14.74 U2#18.9 ; R3#15.2 v1(121.78,53.09) ; LED2#34.1 77.89,180.59 R3#33.2 ; R3#37.2 v1(121.78,138.94) ; R3#28.2 273.98,223.52 LED2#32.1 ; R3#28.2 R4#25.2 ; R3#28.2 v1(268.85,224.79) ; R3#34.2 v1(268.85,181.86) ; R3#34.2 R4#31.2 ; LED2#11.1 77.89,266.45 R3#9.2 ; R4#14.2 R3#17.2 ; R4#14.2 268.85,48.77 255.65,48.77 253.37,51.05 v1(253.37,80.77) 253.37,88.39 254.63,89.66 300.36,89.66 302.26,91.57 302.26,132.59 ; R4#14.2 274.03,50.17 LED1#17.2 ; R3#17.2 273.98,51.82 LED2#25.1 ; R3#17.2 v1(268.85,53.09) ; LED2#7.1 28.87,94.74 R3#7.2 ; R4#38.2 225.01,136.02 LED1#36.2 ; R4#38.2 219.83,134.62 206.63,134.62 204.34,136.91 v1(204.34,166.62) 204.34,175.51 ; H8#21.1 v1(208.41,37.85) ; R4#40.2 175.98,136.02 LED1#39.2 ; R4#40.2 170.81,134.62 157.61,134.62 155.32,136.91 v1(155.32,166.62) 155.32,175.64 300.86,175.64 302.26,174.24 302.26,132.59 ; R4#23.2 R3#21.2 ; H8#11.1 v1(12.32,80.77) ; LED1#26.2 274.03,221.87 R4#25.2 ; LED1#33.2 175.98,178.94 R4#34.2 ; R4#19.2 126.96,7.24 LED1#20.2 ; R3#33.2 v1(72.76,181.86) ; R3#33.2 R4#33.2 ; R4#35.2 28.92,178.94 LED1#31.2 ; R3#21.2 77.89,8.89 LED2#21.1 ; R3#21.2 v1(72.76,10.16) ; 57.28,132.59 106.3,132.59 ; R3#22.2 v1(23.74,10.16) ; R3#22.2 28.87,8.89 LED2#16.1 ; R3#40.2 v1(268.85,138.94) ; R3#40.2 273.98,137.67 LED2#4.1 ; R3#40.2 R4#37.2 ; R4#33.2 77.94,178.94 LED1#34.2 ; LED1#23.2 126.96,221.87 R4#24.2 ; LED2#12.1 175.93,266.45 R3#10.2 ; 8.26,175.51 v1(8.26,166.62) 8.26,136.91 10.54,134.62 23.74,134.62 R4.2 ; H8#27.1 v1(208.41,252.48) ; R3#27.2 v1(72.76,224.79) ; 174.04,143.52 167.51,143.52 ; H8#33.1 v1(208.41,209.55) ; 265.55,143.52 261.23,143.52 261.22,143.51 ; 265.55,143.52 272.08,143.52 ; R3.2 28.87,137.67 LED2.1 ; R3.2 v1(23.74,138.94) ; R3.2 R4.2 ; R4#26.2 R3#26.2 ; R3#26.2 v1(219.83,224.79) ; R3#26.2 224.96,223.52 LED2#27.1 ; U2#22.9 20.44,14.74 ; H8#3.1 v1(110.36,123.7) ; R3#11.2 v1(121.78,267.72) ; U2#9.9 69.46,272.3 ; 69.46,272.3 69.53,272.23 C6#8.2 v1(72.76,271.02) ; 69.46,272.3 65.14,272.3 U1#7.8 ; 57.28,89.66 v1(57.28,80.77) 57.28,51.05 59.56,48.77 72.76,48.77 R4#17.2 ; R4#8.2 R3#9.2 ; R4#8.2 77.94,264.8 LED1#7.2 ; R3#9.2 v1(72.76,267.72) ; 261.22,186.44 261.23,186.45 265.55,186.45 ; 69.46,143.52 69.53,143.45 C6#37.2 v1(72.76,142.24) ; 69.46,143.52 76,143.52 ; R4#37.2 274.03,136.02 LED1#38.2 ; R4#37.2 268.85,134.62 255.65,134.62 253.37,136.91 v1(253.37,166.62) 253.37,175.51 ; R3#7.2 v1(23.74,96.01) ; R4#20.2 175.98,7.24 LED1#16.2 ; H8#39.1 v1(208.41,166.62) ; R4#31.2 274.03,178.94 LED1#32.2 ; R3#24.2 28.87,51.82 LED2#26.1 ; R3#24.2 v1(23.74,53.09) ; U2#14.9 69.46,57.67 ; R3#39.2 77.89,137.67 LED2#40.1 ; R3#39.2 v1(72.76,138.94) ; R4#17.2 R3#14.2 ; R4#17.2 77.94,50.17 LED1#22.2 ; R3#14.2 77.89,51.82 LED2#17.1 ; R3#14.2 v1(72.76,53.09) ; R3#30.2 v1(170.81,224.79) ; R3#30.2 175.93,223.52 LED2#31.1 ; 69.46,14.74 65.14,14.74 U1#16.8 ; 69.46,14.74 U2#23.9 ; 20.44,229.37 U2#29.9 ; 20.44,229.37 16.12,229.37 U1#27.8 ; H8#10.1 v1(257.43,295.4) ; H8#30.1 v1(159.38,209.55) ; H8#38.1 v1(257.43,166.62) ; H8#20.1 v1(110.36,37.85) ; H8#23.1 v1(61.34,252.48) ; H8#29.1 v1(61.34,209.55) ; H8#26.1 v1(257.43,252.48) ; R4#30.2 126.96,178.94 LED1#29.2 ; R3#10.2 v1(170.81,267.72) ; H8#24.1 v1(159.38,252.48) ; 265.55,186.45 U2#31.9 ; H8#40.1 v1(12.32,166.62) ; H8#18.1 v1(110.36,80.77) ; H8#25.1 v1(110.36,252.48) ; U1#25.8 114.16,229.37 118.48,229.37 ; H8#9.1 v1(110.36,295.4) ; H8#32.1 v1(257.43,209.55) ; H8#6.1 v1(12.32,123.7) ; H8#16.1 v1(61.34,37.85) ; 118.48,229.37 U2#24.9 ; H8#8.1 v1(159.38,295.4) ; H8#5.1 v1(208.41,123.7) ; H8#37.1 v1(110.36,166.62)